# EAGLE board Dragino Pan.v1.7 (EAGLE 7.5.0) (continued)
## Tracks (layer width: path | path; a pad name or v marks a point on that pad's centre or on a via) (continued)
  pour Top (rank 2): 18.36,26.55 23.83,30.23 30.23,30.31 30.23,52.79 56.39,52.92 56.16,14.5 70.61,14.5 70.61,110.83 44.2,110.83 44.2,121.24 35.81,121.24 35.81,152.99 53.09,152.99 53.09,159.09 -0.76,159.09 -0.38,26.63
  pour Bottom (rank 2): -0.38,26.63 18.36,26.55 23.83,30.23 30.23,30.31 30.23,52.79 56.39,52.92 56.23,14.5 70.61,14.5 70.61,110.83 44.2,110.83 44.2,121.24 35.81,121.24 35.81,152.99 53.09,152.99 53.09,159.09 -0.76,159.09
  pour Top (isolate 0.406, no thermals): 6.1,35.01 18.8,35.01 18.8,30.69 12.32,30.69 12.32,32.34 6.22,32.34
  pour Top (isolate 0.254, no thermals): 63.63,25.23 69.6,25.23 69.6,20.66 63.88,20.66 63.88,21.67 58.67,21.67 58.67,24.47 63.63,24.47
GPIO1  (via drill 0.3)
  Top 0.254: U1.29 15.62,97.42 13.54,95.33 13.54,83.73 10.29,80.47 9.65,80.47 8.51,79.33 8.51,77.94 9.52,76.92 9.52,72.86 15.49,66.89 v18.41,66.89 | v54.86,65.87 54.86,63.97 58.29,60.54 58.29,38.69 58.72,38.26 R28.1
  Bottom 0.254: v18.41,66.89 19.3,66.89 20.32,65.87 v54.86,65.87
GPIO15
  Top 0.254: U1.38 38.48,102.32 35.8,105 RN1.4
GPIO16  (via drill 0.33)
  Top 0.254: U1.39 41.02,102.19 40.51,102.7 38.99,102.7 35.94,105.75 34.16,105.75 v34.16,106 | v34.16,103.97 30.23,103.97 29.66,104.53 RN1.3
  Bottom 0.254: v34.16,106 v34.16,103.97
GPIO18
  Top 0.254: ROUTER.10 13.33,65.47 13.33,67.9 9.02,72.22 9.02,76.41 5.71,79.71 U1.18
GPIO19  (via drill 0.3)
  Top 0.254: v7.75,82.25 U1.19
  Bottom 0.254: v7.75,82.25 7.75,70.04 10.26,67.53 ROUTER.6
GPIO20  (via drill 0.3, 0.33)
  Top 0.254: v7.37,84.79 U1.20 | v3.56,100.54 3.56,101.05 1.27,103.34 1.27,152.99 2.41,154.13 2.41,154.9 v2.92,155.41
  Bottom 0.203: 8.25,70.31 11.56,67.01 11.56,62.22
  Bottom 0.254: ROUTER.5 11.56,62.22 | 8.25,70.31 8.25,81.62 8.51,81.87 8.51,83.27 7.37,84.41 v7.37,84.79 3.68,84.79 3.17,85.3 3.17,100.16 v3.56,100.54 | v2.92,155.41 2.92,154.52 9.4,148.04 9.4,137.5 11.18,135.72 12.53,135.72 BEE-CON-1.5
GPIO21
  Top 0.254: ROUTER.8 12.8,67.68 8,72.47 U1.16
GPIO22
  Top 0.254: ROUTER.7 11.56,62.16 11.56,68.03 5.47,74.11 U1.17
GPIO23  (via drill 0.3)
  Top 0.254: v7.49,87.33 U1.21
  Bottom 0.254: ROUTER.9 14.1,62.16 14.1,65.36 8.76,70.7 8.76,81.36 9.02,81.62 9.02,83.52 8.13,84.41 8.13,86.19 7.49,86.83 v7.49,87.33
GPIO24  (via drill 0.3)
  Top 0.203: U1.3 v41.02,72.86 | ROUTER.12 17.88,65.33 19.3,66.76 v21.46,66.76
  Bottom 0.203: v21.46,66.76 35.31,66.76
  Bottom 0.254: 35.31,66.76 39.24,66.76 41.02,68.54 v41.02,72.86
GPIO26  (via drill 0.3, 0.33)
  Top 0.254: U1.47 48.61,84.79 48.5,84.9 47.48,84.9 47.12,84.54 47.12,83.14 46.1,82.13 28.83,82.13 v27.94,83.02 | v28.96,102.95 28.96,104.9 RN1.2
  Bottom 0.254: v28.96,102.95 28.07,102.06 28.07,83.14 v27.94,83.02
GPIO27  (via drill 0.3, 0.33)
  Top 0.203: R30.2 12.37,118.25 v11.18,117.05
  Top 0.254: U1.46 44.96,87.33 43.56,85.94 42.16,85.94 40.39,84.16 v25.15,84.16 | RN1.1 27.43,104.37 v27.43,103.59
  Bottom 0.203: v11.18,117.05 11.18,115.53 10.29,114.64 10.29,108.92 11.43,107.78 12.95,107.78 14.1,106.64 14.1,103.46 15.24,102.32 26.16,102.32 v27.43,103.59
  Bottom 0.254: v27.43,103.59 27.43,88.48 25.15,86.19 v25.15,84.16
JUMPSTART  (via drill 0.3)
  Top 0.203: 53.21,64.47 56.77,60.92 56.77,16.47 55.79,15.49 50.46,15.49 49.4,14.44 49.4,12.22 C14.1 | 24.26,95.21 33.02,95.21 35.94,98.13 U1.37 | 21.97,76.54 20.57,77.94 20.57,78.7
  Top 0.254: 24.26,95.21 21.97,95.21 20.57,93.81 20.57,78.7 | 53.21,64.47 53.21,68.54 51.82,69.93 37.97,69.93 37.08,70.82 37.08,75.65 36.32,76.41 22.1,76.41 21.97,76.54 | C14.1 49.38,10.64 v49.4,10.62
  Bottom 0.254: SW1.1 49.76,10.27 v49.4,10.62
LAN_LED
  Top 0.254: 20.7,99.88 U1.31 20.7,100.67 19.81,101.56 19.56,101.56 18.54,102.57 11.81,102.57 10.41,103.97 3.68,103.97 2.79,104.86 2.79,151.47 4.44,153.12 34.53,153.12 R19.1
LED_SYS
  Top 0.254: U1.27 10.54,101.56 9.14,102.95 2.79,102.95 1.78,103.97 1.78,151.98 8.38,158.58 29.04,158.58 SYS.A
N$1  (via drill 0.3)
  Top 0.203: C1.1 R2.1 47.24,58.7 v47.21,58.7 | R1.1 | R1.1 v44.91,58.7
  Bottom 0.203: v44.91,58.7 v47.21,58.7
N$2
  Top 0.254: U2.1 10.54,39.33 L6.P$1 C17.2
  pour Top (isolate 0.254, no thermals): 10.16,35.77 11.43,35.77 11.43,41.1 10.16,41.1
N$3  (via drill 0.3)
  Top 0.203: C2.1 R4.1 v53.31,58.7 | R3.1 50.91,57.78 v50.91,58.7
  Bottom 0.203: v50.91,58.7 v53.31,58.7
N$4  (via drill 0.3)
  Top 0.203: C3.1 R5.1 | v37.41,58.83 37.41,57.78 R6.1
  Top 0.254: R5.1 34.48,57.78 v34.48,58.83
  Bottom 0.254: v34.48,58.83 v37.41,58.83
N$5  (via drill 0.3)
  Top 0.203: C4.1 R7.1 40.91,57.78 v40.91,58.7 | v43.31,58.7 43.33,58.7 R8.1
  Bottom 0.203: v40.91,58.7 v43.31,58.7
N$6
  Top 0.203: R14.2 48.69,156.58 PWR.K
N$7
  Bottom 0.254: 39.81,82.89 38.73,82.89 37.85,82 37.85,78.32 37.08,77.55 R23.1
  Bottom 0.305: U3.41 39.81,82.89
N$8
  Bottom 0.305: U3.27 45.82,77 C20.1
N$9
  Top 0.254: R18.2 C57.1
N$10
  Top 0.254: T1.18 49.08,46.26 49.53,45.8 50.16,45.8 50.42,45.55 R9.2
N$12
  Top 0.406: C7.1 R9.1
N$13
  Top 0.61: U2.6 8,29.78 8.25,29.52 C57.2
N$14
  Top 0.254: U4.5 58.93,17.48
  Top 0.61: R55.1 58.93,17.48 R56.2
N$15  (via drill 0.3)
  Top 0.254: U4.3 R57.1 59.51,27.95 59.13,28.33 v59.13,31 | v59.13,40.85 Q1.1
  Bottom 0.254: v59.13,31 v59.13,40.85
N$16
  Bottom 0.254: R21.2 36.58,80.6 36.83,80.86 36.83,82.63 38.1,83.9 U3.43
N$17
  Top 0.254: T1.13 39.08,46.48 39.75,45.8 40.39,45.8 40.64,45.55 40.64,44.88 R12.2
N$18
  Top 0.406: C10.1 R12.1
N$19
  Top 0.254: U4.7 R22.1
N$20
  Top 0.254: Q1.3 60.64,37.66 R24.2 60.96,37.35 R28.2
N$21
  Top 0.254: U4.6 C58.2
N$22  (via drill 0.33)
  Top 0.254: U$14.5 59.56,74.88 57.78,73.11 45.47,73.11 44.7,73.87 44.7,75.78 44.32,76.16 41.78,76.16 v40.89,77.05
  Bottom 0.254: R20.2 42.29,74.81 C15.1 41.27,74.76 40.89,75.14 v40.89,77.05
N$23
  Top 0.254: R19.2 38.99,156.58 LAN.K
N$24
  Bottom 0.305: U3.11 46.32,88.82 46.99,89.49 48.84,89.49 R27.2
N$25
  Top 0.254: R46.2 U2.3
N$26
  Top 0.254: U2.7 R17.1
N$27
  Top 0.254: C17.1 U2.2
N$28
  Top 0.61: C58.1 60.2,16.01 R29.1
N$29
  Bottom 0.305: U3.9 45.32,89.6 46.74,91.02 47.12,91.02 47.37,91.27 R15.2 C16.1
N$30
  Bottom 0.254: U3.7 44.32,90 45.34,91.02
  Bottom 0.305: 45.46,91.71 R16.2 45.34,91.02
N$31
  Top 0.254: WLAN.K 18.47,156.71 R31.2
N$32
  Top 0.254: R32.2 28.5,156.58 SYS.K
N$34
  Top 0.254: C41.2 61.47,30.95 61.59,31.07 62.61,31.07 62.74,31.2
  Top 0.406: U4.1 62.74,31.2 62.74,32.43 L2.P$1
  pour Top (isolate 0.254, no thermals): 62.48,25.1 63.12,25.1 63.12,28.79 63.12,29.17 63.88,29.17 63.88,35.52 61.72,35.52 61.72,29.55 62.48,29.55
N$35
  Top 0.254: RN1.5 30.46,107.16 24.16,113.46 SENSOR.14
N$36
  Top 0.254: T4.2 R30.1
N$46  (via drill 0.33)
  Top 0.254: RN2.6 14.18,104.61 v17.65,104.61
  Bottom 0.254: SENSOR.9 16.61,105.65 v17.65,104.61
N$47
  Top 0.254: RN1.8 28.06,106.39 26.42,108.03 21.08,108.03 19.15,109.97 SENSOR.11
N$48
  Top 0.254: RN1.6 29.66,106.95 25.69,110.92 SENSOR.13
N$49
  Top 0.406: R13.1 6.63,30.74 U2.5
  Top 0.61: R41.2 R13.1
N$53
  Top 0.305: D25.C 9.5,24.59 9.93,25.03 12.22,25.03 12.65,24.59 12.65,24.67 L3.P$2
  Top 0.813: 12.32,24.59 L3.P$2
  Top 1.422: L3.P$2 17.4,25 17.4,22.31 19.81,22.31 F2.P$1
N$54
  Top 0.254: RN2.7 14.14,105.37 14.73,105.37 15.11,105.75 15.11,106.76 12.83,109.05 12.83,112.61 13.68,113.46 SENSOR.8
N$55
  Top 0.254: U4.2 C41.1
N$56  (via drill 0.33)
  Top 0.254: RN2.5 v16.51,103.72
  Bottom 0.254: v16.51,103.72 16,104.22 16,107.02 15.37,107.65 15.37,112.22 SENSOR.10
N$57
  Top 0.254: RN1.7 28.83,106.28 28.83,106.89 27.05,108.67 21.97,108.67 20.45,110.19 20.45,112.16 SENSOR.12
P0_R_N
  Top 0.203: X11.2-3 32.61,15.2 32.36,15.45 32.36,16.12 32.99,16.75 39.85,16.75 42.27,19.17 42.27,28.56 44.42,30.72 47.12,30.72 | 47.12,30.72 49.75,30.72 50.9,31.87 50.9,37.64 50.13,38.41 47.08,38.41 46.33,39.17 46.33,46.2 T1.17 | 47.12,30.72 47.12,30.07 P1.3
P0_R_P
  Top 0.203: 50.44,36.91 50.44,37.45 49.94,37.95 46.89,37.95 45.87,38.98 45.87,46.16 T1.16 | 50.44,36.91 50.44,32.06 49.56,31.17 44.23,31.17 41.81,28.75 41.81,19.36 39.66,17.2 32.8,17.2 31.9,16.31 31.9,14.21 31.62,13.93 29.72,13.93 29.46,13.67 X11.2-6 | P1.1 50.37,36.84 50.44,36.91
P0_RX_N
  Top 0.203: 28.32,74.78 U1.8 28.32,74.33 27.25,73.26 27.25,72.7 31.64,68.31 37.38,68.31 38.28,67.41 38.28,65.94 38.73,65.49 43.4,65.49 46.35,62.54 46.35,61.72 | 46.35,56.86 46.35,61.68 46.35,61.72 | 46.35,56.86 46.35,55.3 T1.4 | R2.2 46.35,56.86 | D22.P$2 46.35,61.72
P0_RX_P
  Top 0.203: 25.78,74.78 U1.9 25.78,74.28 26.8,73.26 26.8,72.51 31.45,67.85 37.07,67.85 37.82,67.1 37.82,65.75 38.54,65.03 43.21,65.03 45.9,62.35 45.9,61.72 | 45.9,56.86 45.9,61.68 45.9,61.72 | 45.9,56.86 45.9,55.39 T1.5 | R1.2 45.9,56.86 | D22.P$1 45.9,61.72
P0_T_N
  Top 0.203: X11.2-7 28.19,14.18 27.94,13.93 26.03,13.93 25.42,13.32 25.42,11.29 26.07,10.65 35.78,10.65 36.68,11.55 36.68,13.2 37.31,13.83 42.26,13.83 43.41,14.97 43.41,20.06 44.01,20.66 47.37,20.66 | T1.20 53.08,46.58 52.3,45.8 52.3,29.58 51.03,28.31 51.03,21.81 49.88,20.66 47.37,20.66 | P2.3 47.37,19.73 47.37,20.66
P0_T_P
  Top 0.203: X11.2-8 26.92,12.66 26.16,12.66 25.88,12.38 25.88,11.48 26.26,11.11 35.59,11.11 36.22,11.74 36.22,13.39 37.12,14.28 42.07,14.28 42.95,15.17 42.95,20.25 43.82,21.11 49.69,21.11 50.57,22 50.57,26.5 | T1.19 51.08,46.57 51.84,45.8 51.84,29.77 50.57,28.5 50.57,26.5 | P2.1 47.43,26.5 50.57,26.5
P0_TX_N
  Top 0.203: U1.5 35.94,74.43 34.85,73.34 34.85,71.07 36.47,69.45 43.6,69.45 45.29,67.77 45.29,65.53 47.16,63.66 51.35,63.66 52.32,62.69 52.32,61.72 | 52.32,56.87 52.32,61.68 52.32,61.72 | 52.32,56.87 52.32,55.33 T1.1 | R4.2 52.32,56.87 | D15.P$2 52.32,61.72
P0_TX_P
  Top 0.203: U1.6 33.4,74.33 34.39,73.34 34.39,70.88 36.28,68.99 43.42,68.99 44.83,67.58 44.83,65.34 46.97,63.2 51.16,63.2 51.87,62.5 51.87,61.81 51.87,61.72 | 51.87,61.72 51.87,56.86 | 51.87,56.86 51.87,55.36 T1.2 | R3.2 51.87,56.86 | D15.P$1 51.87,61.72
P4_R_N
  Top 0.203: X11.1-3 18.97,15.2 18.47,15.7 18.47,16.88 19.6,18.02 29.94,18.02 31.09,19.17 31.09,30.09 31.97,30.97 37.34,30.97 | 37.34,30.97 40.23,30.97 41,31.74 41,38.02 40.23,38.79 36.92,38.79 36.42,39.3 36.42,46.3 T1.12 | P3.3 37.34,30.97
P4_R_P  (1 unrouted)
  Top 0.203: X11.1-6 15.49,13.67 15.75,13.93 17.53,13.93 18.01,14.41 18.01,17.07 19.41,18.47 29.75,18.47 30.63,19.36 30.63,30.28 31.78,31.43 40.04,31.43 40.54,31.93 40.54,36.79 | 35.96,36.66 39.27,36.66 | T1.11 35.97,46.06 35.97,39.1 36.73,38.34 40.04,38.34 40.54,37.84 40.54,36.79 | P3.1 40.49,36.84 40.54,36.79
P4_RX_N
  Top 0.203: 13.08,74.78 U1.14 13.08,74.25 12.04,73.21 12.04,72.34 13.71,70.67 22.27,70.67 23.11,69.83 23.11,68.99 | 23.11,68.99 23.11,67.92 27.7,63.33 35.48,63.33 36.17,62.64 36.17,61.72 | 36.17,56.86 36.17,61.68 36.17,61.72 | 36.17,56.86 36.17,55.48 T1.9 | T1.9 | R6.2 36.17,56.86 | 23.11,68.99 23.12,69 | D24.P$2 36.17,61.72
P4_RX_P
  Top 0.203: 10.54,74.78 U1.15 10.54,74.25 11.58,73.21 11.58,72.15 13.52,70.21 22.08,70.21 22.66,69.64 22.66,67.73 27.51,62.87 35.29,62.87 35.71,62.45 35.71,61.72 | 35.71,57.36 35.71,61.68 35.71,61.72 | 35.71,56.86 35.71,55.48 35.08,54.85 T1.10 | 35.71,57.36 | R5.2 35.71,56.86 | 35.71,56.86 35.71,57.36 | D24.P$1 35.71,61.72
P4_T_N
  Top 0.203: X11.1-7 14.22,14.44 13.84,14.05 12.57,14.05 11.45,12.94 11.45,11.29 12.48,10.27 23.21,10.27 24.49,11.55 24.49,13.58 27.65,16.75 30.96,16.75 32.61,18.4 32.61,19.8 33.5,20.68 37.34,20.68 | T1.15 43.06,46.95 42.29,46.19 42.29,30.06 41.02,28.79 41.02,21.67 40.03,20.68 37.34,20.68 | P4.3 37.34,20.68
P4_T_P
  Top 0.203: X11.1-8 12.3,12.67 11.91,12.28 11.91,11.48 12.67,10.73 23.02,10.73 24.03,11.74 24.03,13.77 27.46,17.2 30.77,17.2 32.16,18.59 32.16,19.99 33.31,21.14 39.78,21.14 40.54,21.9 40.54,26.63 | T1.14 41.81,46.22 41.81,30.28 40.54,29.01 40.54,26.63 | P4.1 40.53,26.62 40.54,26.63
P4_TX_N
  Top 0.203: U1.11 19.66,73.6 19.66,72.72 20.21,72.17 26.28,72.17 30.94,67.51 30.94,65.46 32.07,64.32 41.19,64.32 42.37,63.14 42.37,61.72 | 42.37,56.86 42.37,61.68 42.37,61.72 | 42.37,56.86 42.37,55.28 T1.6 | R8.2 42.37,56.86 | D23.P$2 42.37,61.72
P4_TX_P
  Top 0.203: U1.12 19.2,73.6 19.2,72.53 20.02,71.71 26.09,71.71 30.48,67.33 30.48,65.27 31.88,63.86 41,63.86 41.91,62.96 41.91,61.72 | 41.91,56.86 41.91,61.68 41.91,61.72 | 41.91,56.86 41.91,55.4 T1.7 | R7.2 41.91,56.86 | D23.P$1 41.91,61.72
PE  (via drill 0.81)  (2 unrouted)
  Top 1.27: v48.01,6.81 48.01,16.09 48.89,16.97 50.55,16.97 55.12,21.55 v55.12,22.94 55.15,22.97 C11.2 | v32.26,27.52 32.26,23.71 32.64,23.33 36.96,23.33 | C10.2 38.63,40.47 v40.64,40.47 | C7.2 48.46,40.47 v50.67,40.47 | C12.2 37.1,33.24 v37.21,33.36 P3.2 | P1.2 v47.37,33.36 | v47.37,22.94 47.37,23.08 P2.2
  Bottom 1.27: X11.P$3 X11.P$2 38.56,1.81 | v40.64,40.47 40.64,33.74 40.26,33.36 | v50.67,40.47 50.67,34.88 49.15,33.36 v47.37,33.36 | v32.26,27.52 24.38,27.52 X11.P$1 | v37.21,33.36 40.26,33.36 | 40.26,33.36 v47.37,33.36 | v37.34,22.94 v47.37,22.94 | v55.12,22.94 v47.37,22.94 | v47.37,33.36 v47.37,22.94
  Bottom 1.422: 38.56,1.81 43.26,1.81 44.58,3.13 44.58,5.29 46.1,6.81 v48.01,6.81
POE_PASSTHROUGH  (via drill 0.58)
  Top 1.016: v24,8.85 v24,5.55
  Bottom 1.016: v24,5.55 29.72,5.55 31.75,3.51 38.61,3.51 40.64,5.55 40.64,5.57 JP2.2 | v24,8.85 18.67,8.85 18.03,9.48 X11.1-4
POE_VIN  (via drill 0.58)
  Top 1.016: v9.4,12.4 D4.A
  Bottom 1.016: JP2.1 36.43,10.6 35.18,9.36 32,9.36 | 32,9.36 30.48,9.36 28.19,7.07 16.13,7.07 12.83,10.37 10.92,10.37 9.4,11.89 v9.4,12.4 | X11.2-4 32,9.36
RING  (via drill 0.6)
  Top 1.27: JP1.1 28.32,55.47 v28.32,23.45
  Bottom 0.406: v28.32,23.45 30.73,23.45 X11.2-5
SD_CLK
  Bottom 0.254: U3.34 42.32,76.77 R20.1
SD_CMD  (via drill 0.33)
  Top 0.254: U$14.3 61.76,73.78 59.56,71.59 41.02,71.59 40,72.6 40,77.55 v40.77,78.32
  Bottom 0.254: U3.36 41.32,78.87 v40.77,78.32
SD_DAT0  (via drill 0.33)
  Top 0.254: U$14.7 57.36,77 54.86,74.51 48.39,74.51 45.97,76.92 v43.81,76.92
  Bottom 0.254: v43.81,76.92 43.81,77.94 44.32,78.44 U3.30
SD_DAT1  (via drill 0.33)
  Top 0.254: U$14.8 56.26,77.04 55.12,75.9 47.75,75.9 45.97,77.68 v44.83,77.68
  Bottom 0.254: v44.83,77.68 44.83,79.39 U3.29
SD_DAT2  (via drill 0.33)
  Top 0.254: U$14.1 63.96,72.93 61.59,70.57 38.23,70.57 37.59,71.2 v37.59,76.41
  Bottom 0.254: v37.59,76.41 37.59,77.3 38.35,78.06 38.35,81.36 38.89,81.9 U3.39
SD_DAT3  (via drill 0.33)
  Top 0.254: U$14.2 62.86,73.61 60.32,71.08 40.51,71.08 39.37,72.22 39.37,76.41 38.99,76.79 v38.86,76.79
  Bottom 0.254: U3.38 39.15,81.4 38.86,81.11 v38.86,76.79
TIP  (via drill 0.6)
  Top 1.27: v26.29,23.45 26.29,52.93 JP1.2
  Bottom 0.406: X11.2-2 34.54,13.93 26.29,13.93 v26.29,23.45
UART_RX  (via drill 0.3)
  Top 0.203: U1.33 25.78,99.4 26.8,98.38 26.8,97.62 26.16,96.98 17.53,96.98 15.49,94.95 15.49,83.4 11.56,79.46 10.03,79.46 v9.52,78.95
  Top 0.254: 25.78,99.4 25.78,101.43 20.45,106.76 17.65,106.76 15.37,109.05 15.37,122 15.75,122.38 U6.3
  Bottom 0.203: ROUTER.13 19.93,60.92 19.18,61.68 19.18,64.98 18.92,65.23 16.76,65.23 9.52,72.47 v9.52,78.95
UART_TX  (via drill 0.3)
  Top 0.203: U1.34 28.32,99.4 27.3,98.38 27.3,97.37 26.42,96.48 17.78,96.48 16,94.7 16,83.14 11.81,78.95 10.67,78.95 10.29,78.57 v10.29,78.06
  Top 0.254: U1.34 28.32,101.43 27.81,101.94 26.03,101.94 17.91,110.07 17.91,122.26 17.27,122.89 U6.2
  Bottom 0.203: ROUTER.14 20.42,64.63 19.3,65.74 17.02,65.74 10.03,72.73 10.03,78.06 v10.29,78.06
USB2_D1_N
  Bottom 0.203: R11.2 29.78,111.59 27.08,114.28 23.02,114.28 22.38,114.92 13.36,114.92 12.83,114.38 12.83,111.46 12.45,111.08 11.69,111.08 SENSOR.5
USB2_D1_P
  Bottom 0.203: R10.1 29.41,112.61 27.27,114.74 23.21,114.74 22.57,115.38 12.42,115.38 11.56,114.51 11.56,113.49 SENSOR.6
USB2_D_N
  Bottom 0.203: U3.47 38.32,85.9 37.49,86.73 37.49,110.61 36.15,111.95 32.61,111.95 32.26,111.59 R11.1
USB2_D_P
  Bottom 0.203: U3.48 38.47,86.4 37.95,86.92 37.95,110.8 36.34,112.4 31.9,112.4 R10.2
USB3_D_N
  Bottom 0.203: U3.2 41.82,90.44 39.55,92.71 39.55,111.63 36.24,114.94 34.21,114.94 30.91,118.24 30.91,127.89 28.62,130.18 13.44,130.18 BEE-CON-1.8
USB3_D_P
  Bottom 0.203: U3.3 42.32,90.51 39.95,92.88 39.95,111.8 36.41,115.35 34.37,115.35 31.32,118.41 31.32,128.06 28.79,130.59 13.66,130.59 BEE-CON-1.7
USB4_D_N
  Bottom 0.203: U3.4 42.82,95.89 47.03,100.11 52.32,100.11 | 52.32,100.11 58.76,100.11 60.56,98.3 USB1.2 | D2.P$1 52.32,100.11
USB4_D_P
  Bottom 0.203: U3.5 43.32,95.82 47.2,99.7 52.32,99.7 | 52.32,99.7 58.59,99.7 59.44,98.86 59.44,98.13 58.72,97.41 USB1.3 | D1.P$1 52.32,99.7
USB_N  (via drill 0.3)
  Top 0.203: U1.50 49.67,78.21 54.58,78.21 55.6,79.24 55.6,84.25 54.7,85.15 51.31,85.15 v51.31,85.4
  Bottom 0.203: v51.31,85.4 51.31,85.15 50.67,85.15 49.92,84.4 U3.17
USB_P  (via drill 0.3)
  Top 0.203: U1.49 49.67,78.67 54.39,78.67 55.14,79.43 55.14,84.06 54.52,84.69 51.31,84.69 v51.31,84.44
  Bottom 0.203: v51.31,84.44 51.31,84.64 51.33,84.67 51.82,84.67 52.07,84.92 52.07,85.68 51.56,86.19 50.8,86.19 49.51,84.9 U3.16
VCC1.8  (via drill 0.33)
  Top 0.254: v52.2,81.11 v49.66,81.11 | v46.35,83.9 46.35,85.94 v46.74,86.32
  Top 0.406: v45.34,94.06 45.34,89.75 46.35,88.73 50.16,88.73 v50.42,88.98
  Bottom 0.203: v52.2,81.11 C32.1 | U3.12 49.72,87.9 50.42,88.6 50.42,88.86 | v50.42,88.98 C33.1 | U3.19 49.91,83.4
  Bottom 0.254: C31.1 50.22,81.11 v49.66,81.11 49.37,81.4 U3.23 | 49.91,83.4 50.67,83.4 51.69,82.38 51.94,82.38 52.2,82.13 v52.2,81.11 | U3.19 46.86,83.4 v46.35,83.9 | v46.74,86.32 46.82,86.4 U3.12
  Bottom 0.406: R16.1 v45.34,94.06 | v50.42,88.98 50.42,88.86
VCC3.3
  Bottom 0.203: 51.18,81.36 50.67,81.87 48.35,81.87 U3.22
  Bottom 0.254: 50.67,86.83 49.25,85.4 U3.15 | 44.32,90.89 43.82,90.39 U3.6 43.82,86.32 | U3.1 40.6,87.9 C30.1 | 35.94,81.62 C26.1 36.07,81.62 36.32,81.87 36.32,83.02 37.72,84.41 39.81,84.41 U3.44 | C24.1 37.08,79.59 37.34,79.84 37.34,82.38 38.35,83.4 U3.42 | 51.18,81.36 51.18,81.31 C27.1
  Bottom 0.305: U3.42 41.4,83.4 | C24.1 C25.1 | C28.1 50.67,86.83 | 44.32,90.89 C29.1 | C23.1 47.57,90.38 46.99,90.38 45.82,89.21 U3.10 45.82,86.73 45.85,86.7 | U3.15 47.34,85.4 47.12,85.17 46.35,85.17 45.85,85.68 45.85,86.19 | U3.44 41.39,84.4 41.4,84.41 | 45.34,81.87 45.37,81.9 U3.22 | U3.1 41.32,86.65 41.4,86.57
  Bottom 0.406: C23.1 48.62,90.97 R27.1 | 45.34,84.92 45.85,84.92 45.85,86.19 45.85,86.7 | 43.82,86.32 43.82,85.17 44.07,84.92
  Bottom 0.813: 45.34,81.87 42.54,81.87 41.4,83.02 41.4,83.4 41.4,84.41 41.4,84.92 | 41.4,84.92 44.07,84.92 45.34,84.92 45.72,84.92 | 41.4,86.57 41.4,84.92
VDD  (via drill 0.3, 0.58)
  Top 0.254: R46.1 v8,41.77 | R57.2 v60.2,29.85
  Top 0.61: U4.8 v62.74,18.5 62.99,18.25 65.34,18.25 C43.1 67.79,18.31 C56.1 | C19.1 11.41,28.22 10.54,29.09 U2.8
  Top 1.27: C19.1 C53.1 19.77,28.22 19.81,28.18 | 19.81,28.18 19.81,30.56 21.01,31.76 21.01,31.83 | 19.81,28.18 F2.P$2 | ROUTER.15 22.96,59.31 21.13,57.49 21.13,31.96 21.01,31.83 | D33.C 21.15,32.73 21.01,32.59 21.01,31.83
  Bottom 0.254: v8,41.77 22.2,41.77 23.62,40.34 23.62,32.88 D33.C | v60.2,29.85 57.15,29.85 56.59,29.29 56.59,19.01 56.08,18.5
  Bottom 1.27: v62.74,18.5 56.08,18.5 55.14,18.5 53.97,17.33 35.66,17.33 34.34,18.65 34.34,31 32.6,32.73 D33.C
  pour Top (isolate 0.406, no thermals): 10.16,31.45 11.43,31.45 11.43,29.55 19.05,29.55 19.05,26.88 10.16,26.88
  pour Top (isolate 0.254, no thermals): 63.25,21.17 63.25,20.02 68.83,20.02 68.83,17.36 62.36,17.36 62.36,21.17
VIN1
  Top 1.27: D4.C 3.61,12.4 4.57,13.37 4.57,19.87 5.69,20.99 6.64,20.99 V1.P$2
  Top 1.524: D5.C D4.C | V1.P$2 6.68,21.02 6.68,19.13 6.71,19.11 L3.P$1
WLAN_LED
  Top 0.254: 18.16,99.88 U1.30 | WLAN.A 19.64,158.07 8.64,158.07 2.29,151.72 2.29,104.48 3.3,103.46 10.03,103.46 11.43,102.06 17.02,102.06 18.16,100.92 U1.30 | U1.30 18.16,99.53 18.29,99.4 18.29,99.9 U1.30
XSCI
  Bottom 0.254: X1.1 34.92,85.99 C18.1 36.02,86.06 36.7,86.06 37.37,85.4 U3.46
XSCO
  Bottom 0.254: X1.3 32.6,84.5 33.4,85.3 35.38,85.3 C21.1 36.1,84.9 U3.45

## Text on the board
tPlace: MODEL Pan v1.7 | 3V3 | +5V
bNames: U$14
tDocu: USB3+ | USB3-